# EasyEDA Pro project Jarvis.eprj, schematic Schematic9
Board Name: Multiplier; Create Date: 2026-04-20; Page Name: P1; Project Name: Jarvis; Schematic Name: Schematic9; Update Date: 2026-04-21; Company: EasyEDA.com; Page Size: A4; Version: V1.0
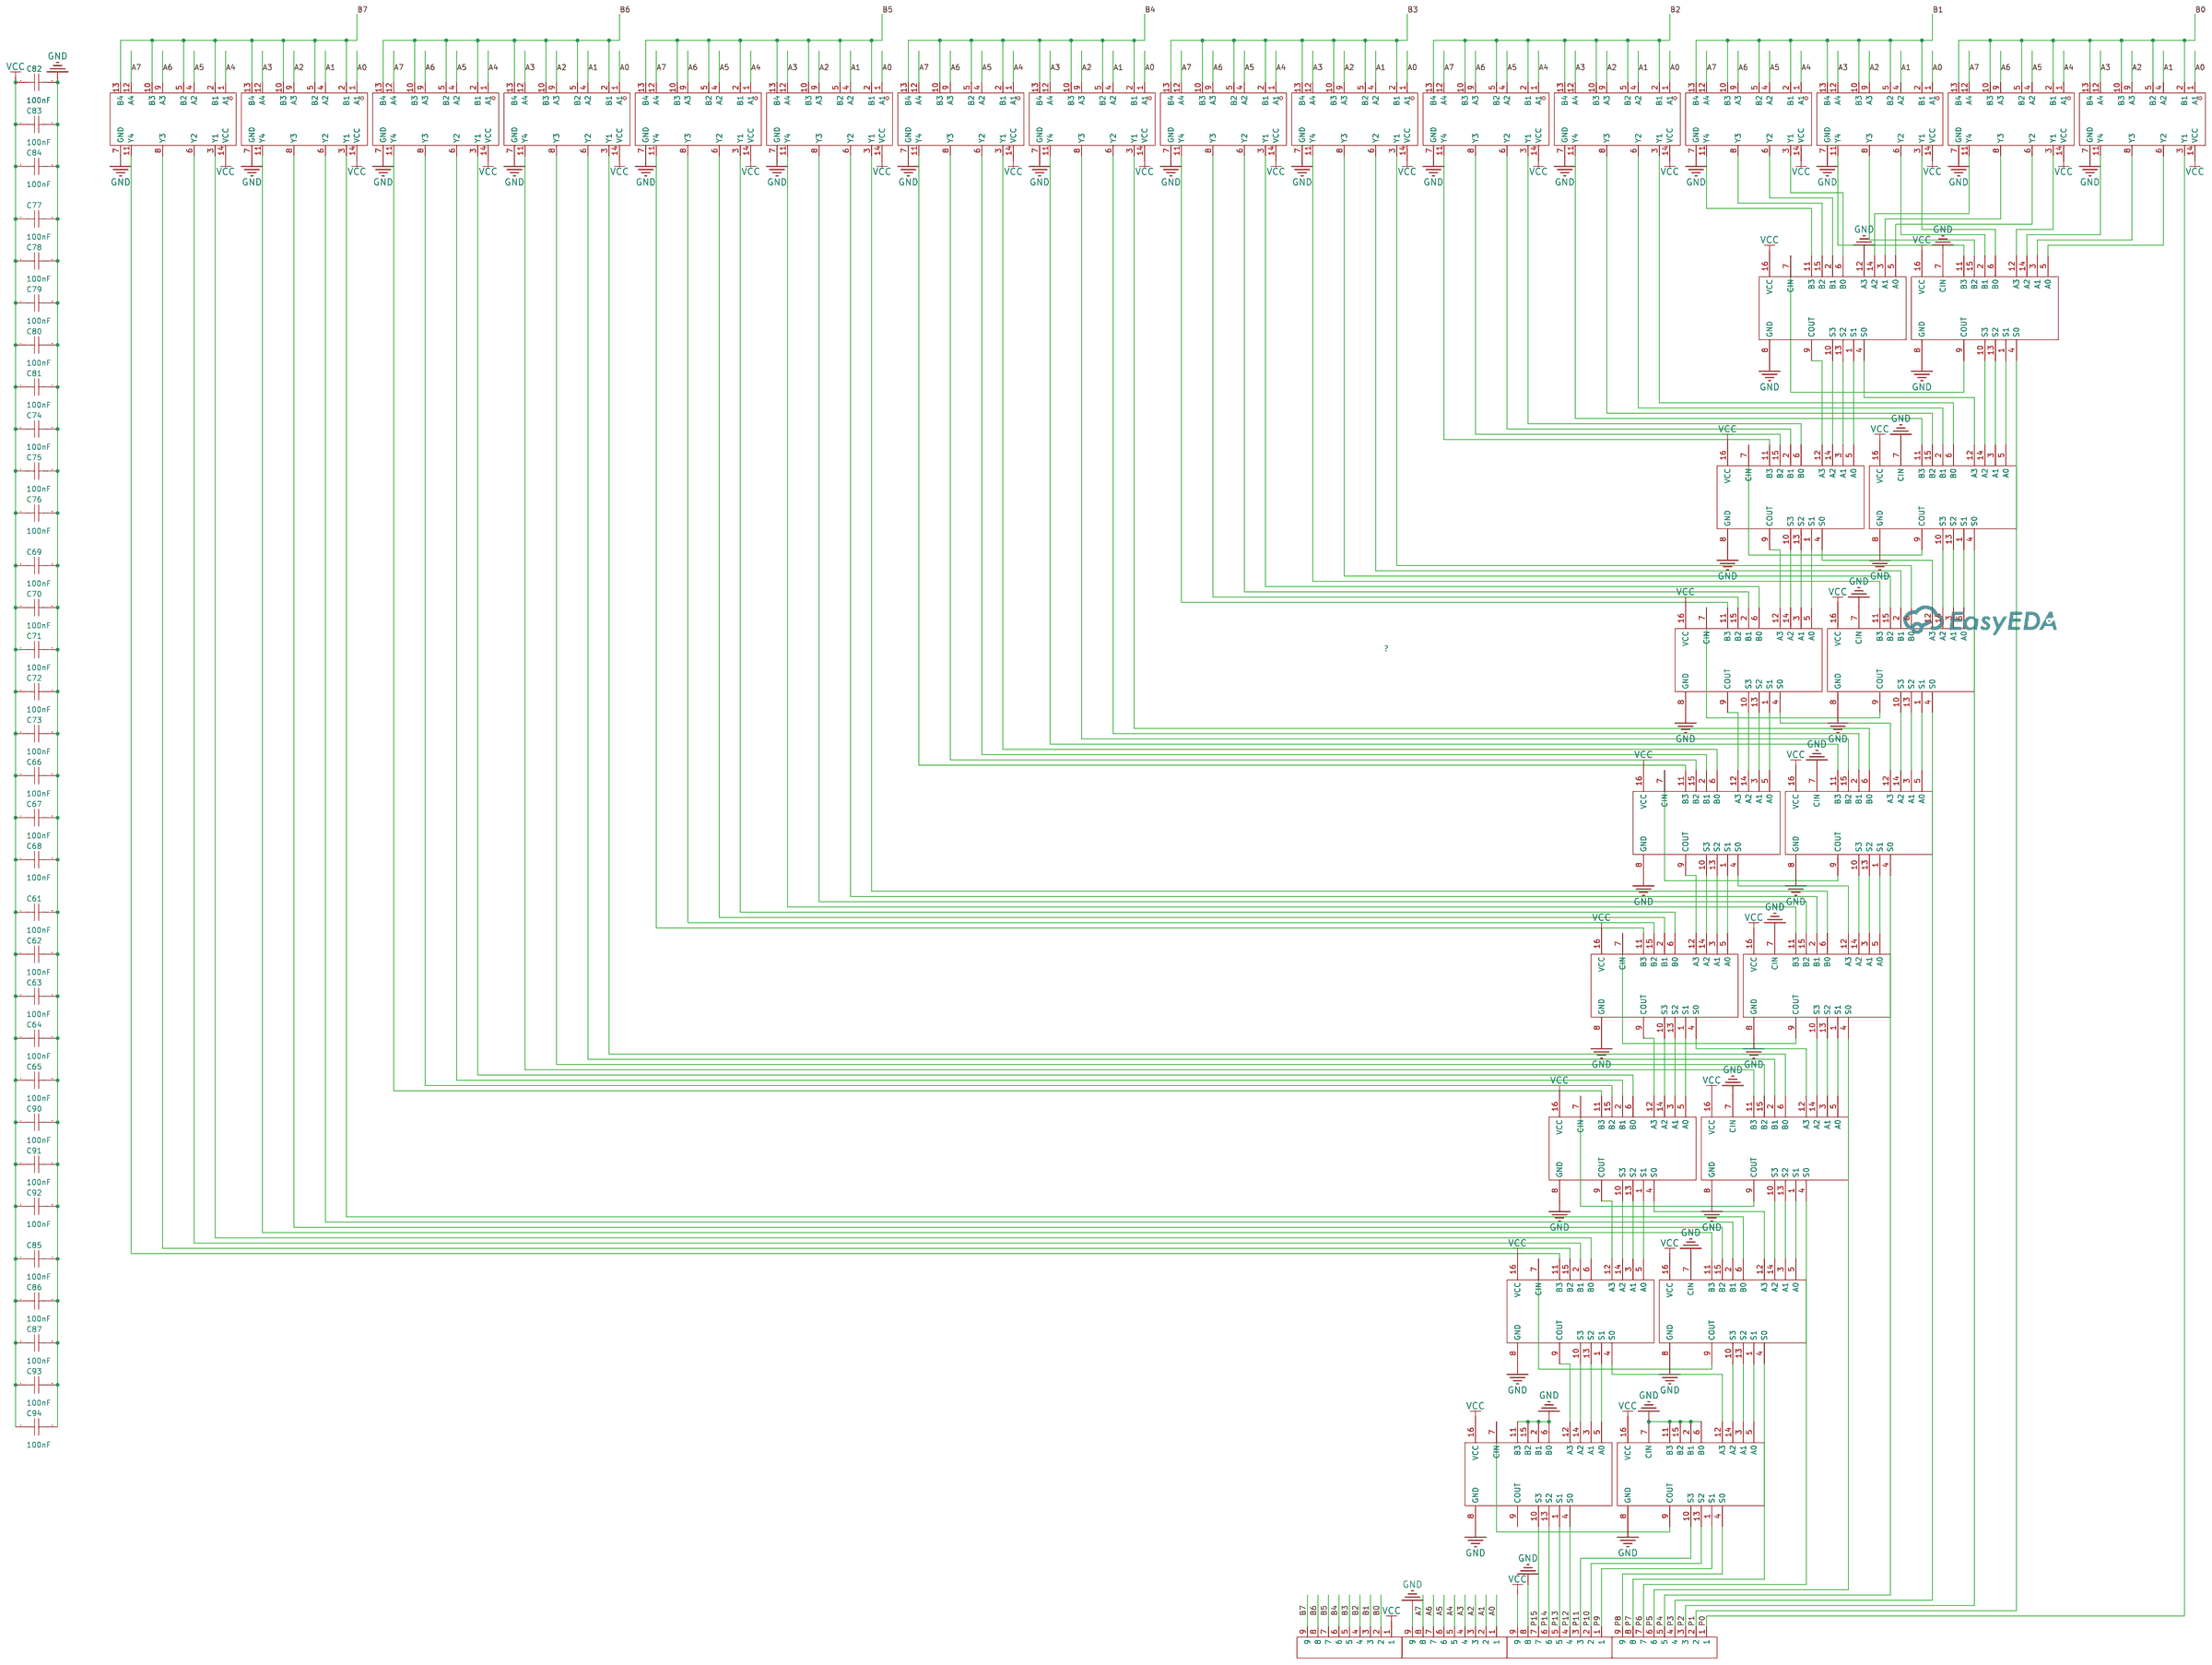
[diagram p9: schematic sheet]

## Parts
C61  100nF  [CAP-TH_L5.0-W2.5-P5.00-D1.0]
C62  100nF  [CAP-TH_L5.0-W2.5-P5.00-D1.0]
C63  100nF  [CAP-TH_L5.0-W2.5-P5.00-D1.0]
C64  100nF  [CAP-TH_L5.0-W2.5-P5.00-D1.0]
C65  100nF  [CAP-TH_L5.0-W2.5-P5.00-D1.0]
C66  100nF  [CAP-TH_L5.0-W2.5-P5.00-D1.0]
C67  100nF  [CAP-TH_L5.0-W2.5-P5.00-D1.0]
C68  100nF  [CAP-TH_L5.0-W2.5-P5.00-D1.0]
C69  100nF  [CAP-TH_L5.0-W2.5-P5.00-D1.0]
C70  100nF  [CAP-TH_L5.0-W2.5-P5.00-D1.0]
C71  100nF  [CAP-TH_L5.0-W2.5-P5.00-D1.0]
C72  100nF  [CAP-TH_L5.0-W2.5-P5.00-D1.0]
C73  100nF  [CAP-TH_L5.0-W2.5-P5.00-D1.0]
C74  100nF  [CAP-TH_L5.0-W2.5-P5.00-D1.0]
C75  100nF  [CAP-TH_L5.0-W2.5-P5.00-D1.0]
C76  100nF  [CAP-TH_L5.0-W2.5-P5.00-D1.0]
C77  100nF  [CAP-TH_L5.0-W2.5-P5.00-D1.0]
C78  100nF  [CAP-TH_L5.0-W2.5-P5.00-D1.0]
C79  100nF  [CAP-TH_L5.0-W2.5-P5.00-D1.0]
C80  100nF  [CAP-TH_L5.0-W2.5-P5.00-D1.0]
C81  100nF  [CAP-TH_L5.0-W2.5-P5.00-D1.0]
C82  100nF  [CAP-TH_L5.0-W2.5-P5.00-D1.0]
C83  100nF  [CAP-TH_L5.0-W2.5-P5.00-D1.0]
C84  100nF  [CAP-TH_L5.0-W2.5-P5.00-D1.0]
C85  100nF  [CAP-TH_L5.0-W2.5-P5.00-D1.0]
C86  100nF  [CAP-TH_L5.0-W2.5-P5.00-D1.0]
C87  100nF  [CAP-TH_L5.0-W2.5-P5.00-D1.0]
C90  100nF  [CAP-TH_L5.0-W2.5-P5.00-D1.0]
C91  100nF  [CAP-TH_L5.0-W2.5-P5.00-D1.0]
C92  100nF  [CAP-TH_L5.0-W2.5-P5.00-D1.0]
C93  100nF  [CAP-TH_L5.0-W2.5-P5.00-D1.0]
C94  100nF  [CAP-TH_L5.0-W2.5-P5.00-D1.0]
U1  MM74HC08N  [PDIP-14_L19.3-W6.5-P2.54-LS7.6-BL]
U2  MM74HC08N  [PDIP-14_L19.3-W6.5-P2.54-LS7.6-BL]
U3  MM74HC08N  [PDIP-14_L19.3-W6.5-P2.54-LS7.6-BL]
U4  MM74HC08N  [PDIP-14_L19.3-W6.5-P2.54-LS7.6-BL]
U5  MM74HC08N  [PDIP-14_L19.3-W6.5-P2.54-LS7.6-BL]
U6  MM74HC08N  [PDIP-14_L19.3-W6.5-P2.54-LS7.6-BL]
U7  MM74HC08N  [PDIP-14_L19.3-W6.5-P2.54-LS7.6-BL]
U8  MM74HC08N  [PDIP-14_L19.3-W6.5-P2.54-LS7.6-BL]
U9  MM74HC08N  [PDIP-14_L19.3-W6.5-P2.54-LS7.6-BL]
U10  MM74HC08N  [PDIP-14_L19.3-W6.5-P2.54-LS7.6-BL]
U11  MM74HC08N  [PDIP-14_L19.3-W6.5-P2.54-LS7.6-BL]
U12  MM74HC08N  [PDIP-14_L19.3-W6.5-P2.54-LS7.6-BL]
U13  MM74HC08N  [PDIP-14_L19.3-W6.5-P2.54-LS7.6-BL]
U14  MM74HC08N  [PDIP-14_L19.3-W6.5-P2.54-LS7.6-BL]
U15  MM74HC08N  [PDIP-14_L19.3-W6.5-P2.54-LS7.6-BL]
U16  MM74HC08N  [PDIP-14_L19.3-W6.5-P2.54-LS7.6-BL]
U69  74HC283P-E  [PDIP-16_L19.3-W6.4-P2.54-LS7.94-BL]
U70  74HC283P-E  [PDIP-16_L19.3-W6.4-P2.54-LS7.94-BL]
U71  74HC283P-E  [PDIP-16_L19.3-W6.4-P2.54-LS7.94-BL]
U72  74HC283P-E  [PDIP-16_L19.3-W6.4-P2.54-LS7.94-BL]
U73  74HC283P-E  [PDIP-16_L19.3-W6.4-P2.54-LS7.94-BL]
U74  74HC283P-E  [PDIP-16_L19.3-W6.4-P2.54-LS7.94-BL]
U75  74HC283P-E  [PDIP-16_L19.3-W6.4-P2.54-LS7.94-BL]
U76  74HC283P-E  [PDIP-16_L19.3-W6.4-P2.54-LS7.94-BL]
U77  74HC283P-E  [PDIP-16_L19.3-W6.4-P2.54-LS7.94-BL]
U78  74HC283P-E  [PDIP-16_L19.3-W6.4-P2.54-LS7.94-BL]
U79  74HC283P-E  [PDIP-16_L19.3-W6.4-P2.54-LS7.94-BL]
U80  74HC283P-E  [PDIP-16_L19.3-W6.4-P2.54-LS7.94-BL]
U82  74HC283P-E  [PDIP-16_L19.3-W6.4-P2.54-LS7.94-BL]
U84  74HC283P-E  [PDIP-16_L19.3-W6.4-P2.54-LS7.94-BL]
U390  HDR2.54-LI-9P  [HDR-TH_9P-P2.54-V-M]
U391  HDR2.54-LI-9P  [HDR-TH_9P-P2.54-V-M]
U392  HDR2.54-LI-9P  [HDR-TH_9P-P2.54-V-M]
U393  HDR2.54-LI-9P  [HDR-TH_9P-P2.54-V-M]
U395  74HC283P-E  [PDIP-16_L19.3-W6.4-P2.54-LS7.94-BL]
U396  74HC283P-E  [PDIP-16_L19.3-W6.4-P2.54-LS7.94-BL]

## Library data of the parts
C61-C87 C90-C94 = 178MU0006: LCSC Part Name: 100nF ±10% 50V; Supplier Part: C5632430; Manufacturer: KNSCHA(科尼盛); Supplier Footprint: 插件,P=2.54mm; JLCPCB Part Class: Extended Part; Datasheet: https://item.szlcsc.com/datasheet/178MU0006/6552585.html; Supplier: LCSC; Tolerance: ±10%; Voltage Rating: 50V; Temperature Coefficient: X7R; Pin Spacing: 2.54mm
U1-U16 = MM74HC08N: Supplier Part: C4472898; Manufacturer: onsemi(安森美); Supplier Footprint: DIP-14; JLCPCB Part Class: Extended Part; Datasheet: https://atta.szlcsc.com/upload/public/pdf/source/20210720/C905181_960C4DCF0E5E69C47778EE69696A80F4.pdf; Supplier: LCSC; Logic Gate Type: With Door; Number of Channels: 4; Supply Voltage: 2V~6V; Quiescent Current (Max): 2uA; Sink Current: 5.2mA; Source Current: 5.2mA; High Level Range (VIH): 1.5V~4.2V; Low Level Range (VIL): 500mV~1.8V; Series: 74HCSeries; Propagation Delay Time: 20ns@6V,50pF; Operating Temperature: -40℃~+85℃
U69-U80 U82 U84 U395 U396 = 74HC283P-E: Supplier Part: C17688236; Manufacturer: RENESAS(瑞萨)/IDT; Datasheet: https://item.szlcsc.com/datasheet/74HC283P-E/18817510.html; Supplier: LCSC
U390-U393 = HDR2.54-LI-9P: Supplier Part: C9900020142; JLCPCB Part Class: Extended Part; Supplier: LCSC

## Nets
GND: C61.2 C62.2 C63.2 C64.2 C65.2 C66.2 C67.2 C68.2 C69.2 C70.2 C71.2 C72.2 C73.2 C74.2 C75.2 C76.2 C77.2 C78.2 C79.2 C80.2 C81.2 C82.2 C83.2 C84.2 C85.2 C86.2 C87.2 C90.2 C91.2 C92.2 C93.2 C94.2 U1.7(GND) U2.7(GND) U3.7(GND) U4.7(GND) U5.7(GND) U6.7(GND) U7.7(GND) U8.7(GND) U9.7(GND) U10.7(GND) U11.7(GND) U12.7(GND) U13.7(GND) U14.7(GND) U15.7(GND) U16.7(GND) U69.7(CIN) U69.8(GND) U70.8(GND) U70.12(A3) U71.7(CIN) U71.8(GND) U72.8(GND) U73.7(CIN) U73.8(GND) U74.8(GND) U75.7(CIN) U75.8(GND) U76.8(GND) U77.7(CIN) U77.8(GND) U78.8(GND) U79.7(CIN) U79.8(GND) U80.8(GND) U82.8(GND) U84.7(CIN) U84.8(GND) U391.8 U393.9 U395.2(B1) U395.6(B0) U395.8(GND) U395.11(B3) U395.15(B2) U396.2(B1) U396.6(B0) U396.7(CIN) U396.8(GND) U396.11(B3) U396.15(B2)
VCC: C61.1 C62.1 C63.1 C64.1 C65.1 C66.1 C67.1 C68.1 C69.1 C70.1 C71.1 C72.1 C73.1 C74.1 C75.1 C76.1 C77.1 C78.1 C79.1 C80.1 C81.1 C82.1 C83.1 C84.1 C85.1 C86.1 C87.1 C90.1 C91.1 C92.1 C93.1 C94.1 U1.14(VCC) U2.14(VCC) U3.14(VCC) U4.14(VCC) U5.14(VCC) U6.14(VCC) U7.14(VCC) U8.14(VCC) U9.14(VCC) U10.14(VCC) U11.14(VCC) U12.14(VCC) U13.14(VCC) U14.14(VCC) U15.14(VCC) U16.14(VCC) U69.16(VCC) U70.16(VCC) U71.16(VCC) U72.16(VCC) U73.16(VCC) U74.16(VCC) U75.16(VCC) U76.16(VCC) U77.16(VCC) U78.16(VCC) U79.16(VCC) U80.16(VCC) U82.16(VCC) U84.16(VCC) U391.9 U392.1 U395.16(VCC) U396.16(VCC)
A0: U1.1(A1) U3.1(A1) U5.1(A1) U7.1(A1) U9.1(A1) U11.1(A1) U13.1(A1) U15.1(A1) U393.1
A1: U1.4(A2) U3.4(A2) U5.4(A2) U7.4(A2) U9.4(A2) U11.4(A2) U13.4(A2) U15.4(A2) U393.2
A2: U1.9(A3) U3.9(A3) U5.9(A3) U7.9(A3) U9.9(A3) U11.9(A3) U13.9(A3) U15.9(A3) U393.3
A3: U1.12(A4) U3.12(A4) U5.12(A4) U7.12(A4) U9.12(A4) U11.12(A4) U13.12(A4) U15.12(A4) U393.4
A4: U2.1(A1) U4.1(A1) U6.1(A1) U8.1(A1) U10.1(A1) U12.1(A1) U14.1(A1) U16.1(A1) U393.5
A5: U2.4(A2) U4.4(A2) U6.4(A2) U8.4(A2) U10.4(A2) U12.4(A2) U14.4(A2) U16.4(A2) U393.6
A6: U2.9(A3) U4.9(A3) U6.9(A3) U8.9(A3) U10.9(A3) U12.9(A3) U14.9(A3) U16.9(A3) U393.7
A7: U2.12(A4) U4.12(A4) U6.12(A4) U8.12(A4) U10.12(A4) U12.12(A4) U14.12(A4) U16.12(A4) U393.8
B0: U1.2(B1) U1.5(B2) U1.10(B3) U1.13(B4) U2.2(B1) U2.5(B2) U2.10(B3) U2.13(B4) U392.2
B1: U3.2(B1) U3.5(B2) U3.10(B3) U3.13(B4) U4.2(B1) U4.5(B2) U4.10(B3) U4.13(B4) U392.3
B2: U5.2(B1) U5.5(B2) U5.10(B3) U5.13(B4) U6.2(B1) U6.5(B2) U6.10(B3) U6.13(B4) U392.4
B3: U7.2(B1) U7.5(B2) U7.10(B3) U7.13(B4) U8.2(B1) U8.5(B2) U8.10(B3) U8.13(B4) U392.5
B4: U9.2(B1) U9.5(B2) U9.10(B3) U9.13(B4) U10.2(B1) U10.5(B2) U10.10(B3) U10.13(B4) U392.6
B5: U11.2(B1) U11.5(B2) U11.10(B3) U11.13(B4) U12.2(B1) U12.5(B2) U12.10(B3) U12.13(B4) U392.7
B6: U13.2(B1) U13.5(B2) U13.10(B3) U13.13(B4) U14.2(B1) U14.5(B2) U14.10(B3) U14.13(B4) U392.8
B7: U15.2(B1) U15.5(B2) U15.10(B3) U15.13(B4) U16.2(B1) U16.5(B2) U16.10(B3) U16.13(B4) U392.9
P0: U1.3(Y1) U390.1
P1: U69.4(S0) U390.2
P2: U71.4(S0) U390.3
P3: U73.4(S0) U390.4
P4: U75.4(S0) U390.5
P5: U77.4(S0) U390.6
P6: U79.4(S0) U390.7
P7: U84.4(S0) U390.8
P8: U390.9 U396.4(S0)
P9: U391.1 U396.1(S1)
P10: U391.2 U396.13(S2)
P11: U391.3 U396.10(S3)
P12: U391.4 U395.4(S0)
P13: U391.5 U395.1(S1)
P14: U391.6 U395.13(S2)
P15: U391.7 U395.10(S3)
$1N1118: U5.3(Y1) U71.6(B0)
$1N1380: U7.3(Y1) U73.6(B0)
$1N2255: U15.3(Y1) U84.6(B0)
$1N2309: U9.3(Y1) U75.6(B0)
$1N2363: U11.3(Y1) U77.6(B0)
$1N2683: U3.3(Y1) U69.6(B0)
$1N2692: U3.6(Y2) U69.2(B1)
$1N2700: U3.8(Y3) U69.15(B2)
$1N2719: U3.11(Y4) U69.11(B3)
$1N2743: U1.6(Y2) U69.5(A0)
$1N2754: U1.8(Y3) U69.3(A1)
$1N2767: U1.11(Y4) U69.14(A2)
$1N2776: U2.3(Y1) U69.12(A3)
$1N2907: U2.6(Y2) U70.5(A0)
$1N2916: U2.8(Y3) U70.3(A1)
$1N2924: U2.11(Y4) U70.14(A2)
$1N2987: U69.9(COUT) U70.7(CIN)
$1N2996: U4.3(Y1) U70.6(B0)
$1N3005: U4.6(Y2) U70.2(B1)
$1N3011: U4.8(Y3) U70.15(B2)
$1N3018: U4.11(Y4) U70.11(B3)
$1N3098: U69.1(S1) U71.5(A0)
$1N3103: U69.13(S2) U71.3(A1)
$1N3111: U69.10(S3) U71.14(A2)
$1N3121: U70.4(S0) U71.12(A3)
$1N3177: U5.6(Y2) U71.2(B1)
$1N3185: U5.8(Y3) U71.15(B2)
$1N3195: U5.11(Y4) U71.11(B3)
$1N3362: U70.1(S1) U72.5(A0)
$1N3366: U70.13(S2) U72.3(A1)
$1N3371: U70.10(S3) U72.14(A2)
$1N3376: U70.9(COUT) U72.12(A3)
$1N3381: U6.3(Y1) U72.6(B0)
$1N3387: U6.6(Y2) U72.2(B1)
$1N3395: U6.8(Y3) U72.15(B2)
$1N3405: U6.11(Y4) U72.11(B3)
$1N3413: U71.9(COUT) U72.7(CIN)
$1N3580: U71.1(S1) U73.5(A0)
$1N3584: U71.13(S2) U73.3(A1)
$1N3589: U71.10(S3) U73.14(A2)
$1N3594: U72.4(S0) U73.12(A3)
$1N3616: U7.6(Y2) U73.2(B1)
$1N3625: U7.8(Y3) U73.15(B2)
$1N3633: U7.11(Y4) U73.11(B3)
$1N3744: U72.1(S1) U74.5(A0)
$1N3749: U72.13(S2) U74.3(A1)
$1N3753: U72.10(S3) U74.14(A2)
$1N3758: U72.9(COUT) U74.12(A3)
$1N3764: U73.9(COUT) U74.7(CIN)
$1N3773: U8.3(Y1) U74.6(B0)
$1N3782: U8.6(Y2) U74.2(B1)
$1N3790: U8.8(Y3) U74.15(B2)
$1N3801: U8.11(Y4) U74.11(B3)
$1N3881: U73.1(S1) U75.5(A0)
$1N3885: U73.13(S2) U75.3(A1)
$1N3890: U73.10(S3) U75.14(A2)
$1N3895: U74.4(S0) U75.12(A3)
$1N3916: U9.6(Y2) U75.2(B1)
$1N3925: U9.8(Y3) U75.15(B2)
$1N3933: U9.11(Y4) U75.11(B3)
$1N4048: U74.1(S1) U76.5(A0)
$1N4052: U74.13(S2) U76.3(A1)
$1N4057: U74.10(S3) U76.14(A2)
$1N4062: U74.9(COUT) U76.12(A3)
$1N4068: U10.3(Y1) U76.6(B0)
$1N4078: U10.6(Y2) U76.2(B1)
$1N4089: U10.8(Y3) U76.15(B2)
$1N4098: U10.11(Y4) U76.11(B3)
$1N4106: U75.9(COUT) U76.7(CIN)
$1N4193: U75.13(S2) U77.3(A1)
$1N4198: U75.10(S3) U77.14(A2)
$1N4203: U76.4(S0) U77.12(A3)
$1N4226: U11.6(Y2) U77.2(B1)
$1N4235: U11.8(Y3) U77.15(B2)
$1N4243: U11.11(Y4) U77.11(B3)
$1N4328: U76.1(S1) U78.5(A0)
$1N4332: U76.13(S2) U78.3(A1)
$1N4337: U76.10(S3) U78.14(A2)
$1N4342: U76.9(COUT) U78.12(A3)
$1N4348: U12.3(Y1) U78.6(B0)
$1N4357: U12.6(Y2) U78.2(B1)
$1N4365: U12.8(Y3) U78.15(B2)
$1N4375: U12.11(Y4) U78.11(B3)
$1N4385: U77.9(COUT) U78.7(CIN)
$1N4554: U78.1(S1) U80.5(A0)
$1N4558: U78.13(S2) U80.3(A1)
$1N4563: U78.10(S3) U80.14(A2)
$1N4568: U78.9(COUT) U80.12(A3)
$1N4695: U13.11(Y4) U79.11(B3)
$1N4709: U77.1(S1) U79.5(A0)
$1N4716: U77.13(S2) U79.3(A1)
$1N4721: U77.10(S3) U79.14(A2)
$1N4726: U78.4(S0) U79.12(A3)
$1N4736: U13.3(Y1) U79.6(B0)
$1N4745: U13.6(Y2) U79.2(B1)
$1N4753: U13.8(Y3) U79.15(B2)
$1N4782: U14.3(Y1) U80.6(B0)
$1N4792: U14.6(Y2) U80.2(B1)
$1N4802: U14.8(Y3) U80.15(B2)
$1N4815: U14.11(Y4) U80.11(B3)
$1N4839: U79.9(COUT) U80.7(CIN)
$1N5236: U79.1(S1) U84.5(A0)
$1N5240: U79.13(S2) U84.3(A1)
$1N5245: U79.10(S3) U84.14(A2)
$1N5250: U80.4(S0) U84.12(A3)
$1N5305: U15.6(Y2) U84.2(B1)
$1N5314: U15.8(Y3) U84.15(B2)
$1N5322: U15.11(Y4) U84.11(B3)
$1N5332: U80.1(S1) U82.5(A0)
$1N5337: U80.13(S2) U82.3(A1)
$1N5342: U80.10(S3) U82.14(A2)
$1N5347: U80.9(COUT) U82.12(A3)
$1N5353: U16.3(Y1) U82.6(B0)
$1N5361: U16.6(Y2) U82.2(B1)
$1N5371: U16.8(Y3) U82.15(B2)
$1N5382: U16.11(Y4) U82.11(B3)
$1N5392: U82.7(CIN) U84.9(COUT)
$1N5426: U75.1(S1) U77.5(A0)
$1N15868: U84.1(S1) U396.5(A0)
$1N15872: U84.13(S2) U396.3(A1)
$1N15877: U84.10(S3) U396.14(A2)
$1N15882: U82.4(S0) U396.12(A3)
$1N15901: U395.7(CIN) U396.9(COUT)
$1N15907: U82.1(S1) U395.5(A0)
$1N15911: U82.13(S2) U395.3(A1)
$1N15916: U82.10(S3) U395.14(A2)
$1N15921: U82.9(COUT) U395.12(A3)

Not connected (* = marked no-connect by the designer): U395 9(COUT)
